# Altium schematic sheet CoinCraftA1.SchDoc (part 2 of 2)
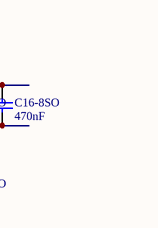
[diagram p6: CoinCraftA1.SchDoc, bottom right]

## Nets
GND: C1.2 C1-1MO.2 C1-1SO.2 C1-2MO.2 C1-2S.2 C1-2SO.2 C1-3MO.2 C1-3S.2 C1-3SO.2 C1-4MO.2 C1-4S.2 C1-4SO.1 C1-5.2 C1-5MO.2 C1-5S.2 C1-5SO.2 C1-6.2 C1-6MO.2 C1-6S.2 C1-6SO.2 C1-7MO.2 C1-7S.2 C1-7SO.2 C1-8MO.2 C1-8S.2 C1-8SO.2 C1_0.2 C1_1.1 C1_1S.2 C1_2.1 C1_3.1 C1_4.1 C1_5.1 C1_6.1 C2-1MO.2 C2-1S.2 C2-1SO.2 C2-2MO.2 C2-2S.2 C2-2SO.2 C2-3MO.2 C2-3S.2 C2-3SO.2 C2-4MO.2 C2-4S.2 C2-4SO.1 C2-5.2 C2-5MO.2 C2-5S.2 C2-5SO.2 C2-6.2 C2-6MO.2 C2-6S.2 C2-6SO.2 C2-7MO.2 C2-7S.2 C2-7SO.2 C2-8MO.2 C2-8S.2 C2-8SO.2 C2_0.2 C2_1.2 C2_2.2 C2_3.2 C2_4.2 C2_5.2 C2_6.2 C3-1MO.2 C3-1S.2 C3-1SO.2 C3-2MO.2 C3-2S.2 C3-2SO.2 C3-3MO.2 C3-3S.2 C3-3SO.2 C3-4MO.2 C3-4S.2 C3-4SO.2 C3-5.2 C3-5MO.2 C3-5S.2 C3-5SO.2 C3-6.2 C3-6MO.2 C3-6S.2 C3-6SO.2 C3-7MO.2 C3-7S.2 C3-7SO.2 C3-8MO.2 C3-8S.2 C3-8SO.2 C3_0.2 C4-1MO.2 C4-1S.2 C4-1SO.2 C4-2MO.2 C4-2S.2 C4-2SO.2 C4-3MO.2 C4-3S.2 C4-3SO.2 C4-4MO.2 C4-4S.2 C4-4SO.2 C4-5.2 C4-5MO.2 C4-5S.2 C4-5SO.2 C4-6.2 C4-6MO.2 C4-6S.2 C4-6SO.2 C4-7MO.2 C4-7S.2 C4-7SO.2 C4-8MO.2 C4-8S.2 C4-8SO.2 C4_0.2 C5-1MO.2 C5-1S.2 C5-1SO.2 C5-2MO.2 C5-2S.2 C5-2SO.1 C5-3MO.2 C5-3S.2 C5-3SO.2 C5-4MO.2 C5-4S.2 C5-4SO.2 C5-5.2 C5-5MO.2 C5-5S.2 C5-5SO.2 C5-6.2 C5-6MO.2 C5-6S.2 C5-6SO.2 C5-7MO.2 C5-7S.2 C5-7SO.2 C5-8MO.2 C5-8S.2 C5-8SO.2 C5_0.2 C6-1MO.2 C6-1S.2 C6-1SO.2 C6-2MO.2 C6-2S.2 C6-2SO.1 C6-3MO.2 C6-3S.2 C6-3SO.2 C6-4MO.2 C6-4S.2 C6-4SO.2 C6-5.2 C6-5MO.2 C6-5S.2 C6-5SO.2 C6-6.2 C6-6MO.2 C6-6S.2 C6-6SO.2 C6-7MO.2 C6-7S.2 C6-7SO.2 C6-8MO.2 C6-8S.2 C6-8SO.2 C6_0.2 C7-1MO.2 C7-1S.2 C7-1SO.2 C7-2MO.2 C7-2S.2 C7-2SO.1 C7-3MO.2 C7-3S.2 C7-3SO.2 C7-4MO.2 C7-4S.2 C7-4SO.2 C7-5.2 C7-5MO.2 C7-5S.2 C7-5SO.2 C7-6.2 C7-6MO.2 C7-6S.2 C7-6SO.2 C7-7MO.2 C7-7S.2 C7-7SO.2 C7-8MO.2 C7-8S.2 C7-8SO.2 C7_0.2 C8-1MO.2 C8-1S.2 C8-1SO.2 C8-2MO.2 C8-2S.2 C8-2SO.1 C8-3MO.2 C8-3S.2 C8-3SO.2 C8-4MO.2 C8-4S.2 C8-4SO.2 C8-5.2 C8-5MO.2 C8-5S.2 C8-5SO.2 C8-6.2 C8-6MO.2 C8-6S.2 C8-6SO.2 C8-7MO.2 C8-7S.2 C8-7SO.2 C8-8MO.2 C8-8S.2 C8-8SO.2 C8_0.2 C9-1MO.2 C9-1S.2 C9-1SO.2 C9-2MO.2 C9-2S.2 C9-2SO.1 C9-3MO.2 C9-3S.2 C9-3SO.1 C9-4MO.2 C9-4S.2 C9-4SO.2 C9-5.2 C9-5MO.2 C9-5S.2 C9-5SO.2 C9-6.2 C9-6MO.2 C9-6S.2 C9-6SO.2 C9-7MO.2 C9-7S.2 C9-7SO.1 C9-8MO.2 C9-8S.2 C9-8SO.2 C9_0.2 C10-1MO.2 C10-1S.2 C10-1SO.2 C10-2MO.2 C10-2S.2 C10-2SO.1 C10-3MO.2 C10-3S.2 C10-3SO.1 C10-4MO.2 C10-4S.2 C10-4SO.2 C10-5.2 C10-5MO.2 C10-5S.2 C10-5SO.2 C10-6.2 C10-6MO.2 C10-6S.2 C10-6SO.2 C10-7MO.2 C10-7S.2 C10-7SO.2 C10-8MO.2 C10-8S.2 C10-8SO.2 C10_0.2 C11-1MO.2 C11-1SO.1 C11-2MO.2 C11-2S.2 C11-2SO.2 C11-3MO.2 C11-3S.2 C11-3SO.2 C11-5.2 C11-5MO.2 C11-5SO.2 C11-6.2 C11-6S.2 C11-7S.2 C11-8MO.2 C11-8SO.2 C11_0.2 C11_1.2 C11_2.2 C11_3.2 C11_4.2 C12-1MO.2 C12-1SO.2 C12-2MO.2 C12-2S.2 C12-2SO.2 C12-3MO.2 C12-3S.2 C12-3SO.1 C12-5.2 C12-5MO.2 C12-5SO.2 C12-6.2 C12-6S.2 C12-7S.2 C12-8MO.2 C12-8SO.2 C12_0.2 C12_1.2 C12_2.2 C12_3.2 C12_4.2 C13-2S.2 C13-3S.2 C13-5.2 C13-5MO.2 C13-5SO.2 C13-6.2 C13-6S.2 C13-7S.2 C13-8MO.2 C13-8SO.2 C13_0.2 C13_1.2 C13_2.2 C13_3.2 C13_4.2 C14-5.2 C14-5MO.2 C14-5SO.2 C14-6.2 C14-8MO.2 C14-8SO.2 C14_0.2 C14_1.2 C14_2.2 C14_3.2 C14_4.2 C15-5.2 C15-6.2 C15-8MO.2 C15-8SO.2 C15_0.2 C15_1.2 C15_2.2 C15_3.2 C15_4.2 C16-5.2 C16-6.2 C16-8MO.2 C16-8SO.2 C16_0.2 C16_1.2 C16_2.2 C16_3.2 C16_4.2 C17.2 C17_0.2 C17_1.2 C17_2.2 C17_3.2 C17_4.2 C18_0.2 C18_1.2 C18_2.2 C18_3.2 C18_4.2 C19_1.2 C19_2.2 C19_3.2 C19_4.2 C20-5.2 C20-6.2 C20_0.2 C20_1.2 C20_2.2 C20_3.2 C20_4.2 C21-5.2 C21-6.2 C21_0.2 C21_1.2 C21_2.2 C21_3.2 C21_4.2 C22-5.2 C22-6.2 C22_0.2 C22_1.2 C22_2.2 C22_3.2 C22_4.2 C23-5.2 C23-6.2 C23_0.2 C23_1.2 C23_2.2 C23_3.2 C23_4.2 C24-5.2 C24-6.2 C24_0.2 C24_1.2 C24_3.2 C24_4.2 C25-5.2 C25-6.2 C25_0.2 C25_1.2 C25_3.2 C25_4.2 C26-5.2 C26-6.2 C26_0.2 C26_1.2 C26_2.2 C26_3.2 C26_4.2 C27-5.2 C27-6.2 C27_0.2 C28_0.2 C31_1.2 C31_2.2 C31_3.2 C31_4.2 C32_1.2 C32_2.2 C32_3.2 C32_4.2 C33_1.2 C33_2.2 C33_3.2 C33_4.2 C34.2 C34_1.2 C34_2.2 C34_3.2 C34_4.2 C35_1.2 C35_2.2 C35_3.2 C35_4.2 C36_1.2 C36_2.2 C36_3.2 C36_4.2 C37_1.2 C37_2.2 C37_3.2 C37_4.2 C38_1.2 C38_2.2 C38_3.2 C38_4.2 C39_1.2 C39_2.2 C39_3.2 C39_4.2 C40_1.2 C40_2.2 C40_3.2 C40_4.2 C40_5.2 C40_6.2 C41_1.2 C41_2.2 C41_3.2 C41_4.2 C41_5.2 C41_6.2 C42_1.2 C42_2.2 C42_3.2 C42_4.2 C42_5.2 C42_6.2 C43.2 C43_1.2 C43_2.2 C43_3.2 C43_4.2 C43_5.2 C43_6.2 C44.2 C44_1.2 C44_2.2 C44_3.2 C44_4.2 C44_5.2 C44_6.2 C45_1.2 C45_2.2 C45_3.2 C45_4.2 C45_5.2 C45_6.2 C46_1.2 C46_2.2 C46_3.2 C46_4.2 C46_5.2 C46_6.2 C47_5.2 C47_6.2 C48_5.2 C48_6.2 C49_5.2 C49_6.2 C50_5.2 C50_6.2 C51_1.2 C51_2.2 C51_3.2 C51_4.2 C51_5.2 C51_6.2 C52_1.2 C52_2.2 C52_3.2 C52_4.2 C52_5.2 C52_6.2 C53_1.2 C53_2.2 C53_3.2 C53_4.2 C53_5.2 C53_6.2 C54_1.2 C54_2.2 C54_3.2 C54_4.2 C54_5.2 C54_6.2 C55_1.2 C55_2.2 C55_3.2 C55_4.2 C55_5.2 C55_6.2 C56_1.2 C56_2.2 C56_3.2 C56_4.2 C57_1.2 C57_2.2 C57_3.2 C57_4.2 C58_1.2 C58_2.2 C58_3.2 C58_4.2 C61_1.2 C61_2.2 C61_3.2 C61_4.2 C61_5.2 C61_6.2 C62_1.2 C62_2.2 C62_3.2 C62_4.2 C62_5.2 C62_6.2 C63.2 C63_1.2 C63_2.2 C63_3.2 C63_4.2 C63_5.2 C63_6.2 C64_1.2 C64_2.2 C64_3.2 C64_4.2 C64_5.2 C64_6.2 C65_1.2 C65_2.2 C65_3.2 C65_4.2 C65_5.2 C65_6.2 C66_1.2 C66_2.2 C66_3.2 C66_4.2 C66_5.2 C66_6.2 C67_1.2 C67_2.2 C67_3.2 C67_4.2 C67_5.2 C67_6.2 C68_1.2 C68_2.2 C68_3.2 C68_4.2 C68_5.2 C68_6.2 C72.2 C73.2 C74.2 C75.2 C76.2 C81_2.2 C82_2.2 C85.2 C86.2 C187.2 C206.1 C211.2 C229.2 C231.2 C233.2 C234.2 C237.2 C248.2 C249.2 C250.2 C251.2 C325.2 C358.2 C359.2 C360.2 C364.2 C366.2 C367.2 C371.2 C374.2 C375.2 C376.2 C377.2 C378.2 C379.2 C383.2 C387.2 C503.2 C504.2 C505.2 C506.2 C507.2 C508.2 C509.2 C510.2 C511.2 C512.2 C513.2 C514.2 C515.2 C516.2 C517.2 C518.2 C519.2 C520.2 C521.2 C522.2 C523.2 C524.2 C525.2 C526.2 C528.2 C529.2 C530.2 C531.2 C532.2 C533.2 C534.2 C536.2 D3.1(A1) D3.2(A2) D4.1(C) D5.1(C) D6.1(C) D7.1(C) D8.2(A) D9.2(A) D14.2(A) D16.2(AAAA) D16.5(C4) J1.3 J2.2 J3.5 J3.6 J3.7 J3.8 J3.9 J4.1 J4.3 J4.5 J5.1 J5.3 J5.5 Q2_1.1(S) Q2_1.2(S) Q2_1.3(S) Q2_2.1(S) Q2_2.2(S) Q2_2.3(S) Q2_3.1(S) Q2_3.2(S) Q2_3.3(S) Q2_4.1(S) Q2_4.2(S) Q2_4.3(S) Q2_5.1(S) Q2_5.2(S) Q2_5.3(S) Q2_6.1(S) Q2_6.2(S) Q2_6.3(S) Q3_1.1(S) Q3_1.2(S) Q3_1.3(S) Q3_2.1(S) Q3_2.2(S) Q3_2.3(S) Q3_3.1(S) Q3_3.2(S) Q3_3.3(S) Q3_4.1(S) Q3_4.2(S) Q3_4.3(S) Q3_5.1(S) Q3_5.2(S) Q3_5.3(S) Q3_6.1(S) Q3_6.2(S) Q3_6.3(S) Q7.2(E) R4.1 R6.1 R7.2 R8.2 R10.2 R15.1 R18.1 R20.1 R32.2 R35.2 R40.1 R59.1 R60.1 R61.1 U1.9(VSS) U1.20(AVSS) U1.25(VSS) U1.41(VSS) U1_1.4(GND) U1_1.9(EP) U1_2.4(GND) U1_2.9(EP) U1_3.4(GND) U1_3.9(EP) U1_4.4(GND) U1_4.9(EP) U1_5.4(GND) U1_5.9(EP) U1_6.4(GND) U1_6.9(EP) U2.16(CLKMUX) U2.21(GND) U3.16(CLKMUX) U3.21(GND) U4.16(CLKMUX) U4.21(GND) U5.16(CLKMUX) U5.21(GND) U6.16(CLKMUX) U6.21(GND) U7.16(CLKMUX) U7.21(GND) U8.16(CLKMUX) U8.21(GND) U9.16(CLKMUX) U9.21(GND) U18.2(GND) U19.6(GND) U19.7(GND) U24.6(GND) U24.7(GND)
0.8V: C1.1 C1-1MO.1 C1-1SO.1 C1-2MO.1 C1-2S.1 C1-2SO.1 C1-3MO.1 C1-3S.1 C1-3SO.1 C1-4MO.1 C1-4S.1 C1-4SO.2 C1-5MO.1 C1-5S.1 C1-5SO.1 C1-6MO.1 C1-6S.1 C1-6SO.1 C1-7MO.1 C1-7S.1 C1-7SO.1 C1-8MO.1 C1-8S.1 C1-8SO.1 C1_0.1 C1_1S.1 C2-1MO.1 C2-1S.1 C2-1SO.1 C2-2MO.1 C2-2S.1 C2-2SO.1 C2-3MO.1 C2-3S.1 C2-3SO.1 C2-4MO.1 C2-4S.1 C2-4SO.2 C2-5MO.1 C2-5S.1 C2-5SO.1 C2-6MO.1 C2-6S.1 C2-6SO.1 C2-7MO.1 C2-7S.1 C2-7SO.1 C2-8MO.1 C2-8S.1 C2-8SO.1 C2_0.1 C3-1MO.1 C3-1S.1 C3-1SO.1 C3-2MO.1 C3-2S.1 C3-2SO.1 C3-3MO.1 C3-3S.1 C3-3SO.1 C3-4MO.1 C3-4S.1 C3-4SO.1 C3-5MO.1 C3-5S.1 C3-5SO.1 C3-6MO.1 C3-6S.1 C3-6SO.1 C3-7MO.1 C3-7S.1 C3-7SO.1 C3-8MO.1 C3-8S.1 C3-8SO.1 C3_0.1 C4-1MO.1 C4-1S.1 C4-1SO.1 C4-2MO.1 C4-2S.1 C4-2SO.1 C4-3MO.1 C4-3S.1 C4-3SO.1 C4-4MO.1 C4-4S.1 C4-4SO.1 C4-5MO.1 C4-5S.1 C4-5SO.1 C4-6MO.1 C4-6S.1 C4-6SO.1 C4-7MO.1 C4-7S.1 C4-7SO.1 C4-8MO.1 C4-8S.1 C4-8SO.1 C4_0.1 C5-1MO.1 C5-1S.1 C5-1SO.1 C5-2MO.1 C5-2S.1 C5-2SO.2 C5-3MO.1 C5-3S.1 C5-3SO.1 C5-4MO.1 C5-4S.1 C5-4SO.1 C5-5MO.1 C5-5S.1 C5-5SO.1 C5-6MO.1 C5-6S.1 C5-6SO.1 C5-7MO.1 C5-7S.1 C5-7SO.1 C5-8MO.1 C5-8S.1 C5-8SO.1 C5_0.1 C6-1MO.1 C6-1S.1 C6-1SO.1 C6-2MO.1 C6-2S.1 C6-2SO.2 C6-3MO.1 C6-3S.1 C6-3SO.1 C6-4MO.1 C6-4S.1 C6-4SO.1 C6-5MO.1 C6-5S.1 C6-5SO.1 C6-6MO.1 C6-6S.1 C6-6SO.1 C6-7MO.1 C6-7S.1 C6-7SO.1 C6-8MO.1 C6-8S.1 C6-8SO.1 C6_0.1 C7-1MO.1 C7-1S.1 C7-1SO.1 C7-2MO.1 C7-2S.1 C7-2SO.2 C7-3MO.1 C7-3S.1 C7-3SO.1 C7-4MO.1 C7-4S.1 C7-4SO.1 C7-5MO.1 C7-5S.1 C7-5SO.1 C7-6MO.1 C7-6S.1 C7-6SO.1 C7-7MO.1 C7-7S.1 C7-7SO.1 C7-8MO.1 C7-8S.1 C7-8SO.1 C7_0.1 C8-1MO.1 C8-1S.1 C8-1SO.1 C8-2MO.1 C8-2S.1 C8-2SO.2 C8-3MO.1 C8-3S.1 C8-3SO.1 C8-4MO.1 C8-4S.1 C8-4SO.1 C8-5MO.1 C8-5S.1 C8-5SO.1 C8-6MO.1 C8-6S.1 C8-6SO.1 C8-7MO.1 C8-7S.1 C8-7SO.1 C8-8MO.1 C8-8S.1 C8-8SO.1 C8_0.1 C9-1MO.1 C9-1S.1 C9-1SO.1 C9-2MO.1 C9-2S.1 C9-2SO.2 C9-3MO.1 C9-3S.1 C9-3SO.2 C9-4MO.1 C9-4S.1 C9-4SO.1 C9-5MO.1 C9-5S.1 C9-5SO.1 C9-6MO.1 C9-6S.1 C9-6SO.1 C9-7MO.1 C9-7S.1 C9-7SO.2 C9-8MO.1 C9-8S.1 C9-8SO.1 C9_0.1 C10-1MO.1 C10-1S.1 C10-1SO.1 C10-2MO.1 C10-2S.1 C10-2SO.2 C10-3MO.1 C10-3S.1 C10-3SO.2 C10-4MO.1 C10-4S.1 C10-4SO.1 C10-5MO.1 C10-5S.1 C10-5SO.1 C10-6MO.1 C10-6S.1 C10-6SO.1 C10-7MO.1 C10-7S.1 C10-7SO.1 C10-8MO.1 C10-8S.1 C10-8SO.1 C10_0.1 C11-1MO.1 C11-1SO.2 C11-2MO.1 C11-2S.1 C11-2SO.1 C11-3MO.1 C11-3S.1 C11-3SO.1 C11-5MO.1 C11-5SO.1 C11-6S.1 C11-7S.1 C11-8MO.1 C11-8SO.1 C11_0.1 C11_1.1 C11_2.1 C11_3.1 C11_4.1 C12-1MO.1 C12-1SO.1 C12-2MO.1 C12-2S.1 C12-2SO.1 C12-3MO.1 C12-3S.1 C12-3SO.2 C12-5MO.1 C12-5SO.1 C12-6S.1 C12-7S.1 C12-8MO.1 C12-8SO.1 C12_0.1 C12_1.1 C12_2.1 C12_3.1 C12_4.1 C13-2S.1 C13-3S.1 C13-5MO.1 C13-5SO.1 C13-6S.1 C13-7S.1 C13-8MO.1 C13-8SO.1 C13_0.1 C13_1.1 C13_2.1 C13_3.1 C13_4.1 C14-5MO.1 C14-5SO.1 C14-8MO.1 C14-8SO.1 C14_0.1 C14_1.1 C14_2.1 C14_3.1 C14_4.1 C15-8MO.1 C15-8SO.1 C15_0.1 C15_1.1 C15_2.1 C15_3.1 C15_4.1 C16-8MO.1 C16-8SO.1 C16_0.1 C16_1.1 C16_2.1 C16_3.1 C16_4.1 C17_0.1 C17_1.1 C17_2.1 C17_3.1 C17_4.1 C18_0.1 C18_1.1 C18_2.1 C18_3.1 C18_4.1 C19_1.1 C19_2.1 C19_3.1 C19_4.1 C20_0.1 C20_1.1 C20_2.1 C20_3.1 C20_4.1 C21_0.1 C21_1.1 C21_2.1 C21_3.1 C21_4.1 C22_0.1 C22_1.1 C22_2.1 C22_3.1 C22_4.1 C23_0.1 C23_1.1 C23_2.1 C23_3.1 C23_4.1 C24_0.1 C24_1.1 C24_3.1 C24_4.1 C25_0.1 C25_1.1 C25_3.1 C25_4.1 C26_0.1 C26_1.1 C26_2.1 C26_3.1 C26_4.1 C27_0.1 C28_0.1 C40_5.1 C40_6.1 C41_5.1 C41_6.1 C42_5.1 C42_6.1 C43_5.1 C43_6.1 C44_5.1 C44_6.1 C45_5.1 C45_6.1 C46_5.1 C46_6.1 C47_5.1 C47_6.1 C48_5.1 C48_6.1 C49_5.1 C49_6.1 C50_5.1 C50_6.1 C51_5.1 C51_6.1 C52_5.1 C52_6.1 C53_5.1 C53_6.1 C54_5.1 C54_6.1 C55_5.1 C55_6.1 C61_1.1 C61_2.1 C61_3.1 C61_4.1 C61_5.1 C61_6.1 C62_1.1 C62_2.1 C62_3.1 C62_4.1 C62_5.1 C62_6.1 C63_1.1 C63_2.1 C63_3.1 C63_4.1 C63_5.1 C63_6.1 C64_1.1 C64_2.1 C64_3.1 C64_4.1 C64_5.1 C64_6.1 C65_1.1 C65_2.1 C65_3.1 C65_4.1 C65_5.1 C65_6.1 C66_1.1 C66_2.1 C66_3.1 C66_4.1 C66_5.1 C66_6.1 C67_1.1 C67_2.1 C67_3.1 C67_4.1 C67_5.1 C67_6.1 C68_1.1 C68_2.1 C68_3.1 C68_4.1 C68_5.1 C68_6.1 C81_2.1 C82_2.1 C358.1 C359.1 C360.1 C364.1 C366.1 C367.1 C371.1 C374.1 C375.1 C376.1 C377.1 C378.1 C379.1 C383.1 C387.1 C503.1 C504.1 C505.1 C506.1 C507.1 C508.1 C509.1 C510.1 C511.1 C512.1 C513.1 C514.1 C515.1 C516.1 C517.1 C518.1 C519.1 C520.1 C521.1 C522.1 C523.1 C524.1 C525.1 C526.1 C528.1 C529.1 C530.1 C531.1 C532.1 C533.1 C534.1 C536.1 L1_1.2 L1_2.2 L1_3.2 L1_4.2 L1_5.2 L1_6.2 R11.2 R14.2 R43.2 U2.1(VDD) U2.8(VDD) U2.9(VDD) U2.10(VDD) U2.11(VDD) U2.19(VDD) U2.20(VDD) U3.1(VDD) U3.8(VDD) U3.9(VDD) U3.10(VDD) U3.11(VDD) U3.19(VDD) U3.20(VDD) U4.1(VDD) U4.8(VDD) U4.9(VDD) U4.10(VDD) U4.11(VDD) U4.19(VDD) U4.20(VDD) U5.1(VDD) U5.8(VDD) U5.9(VDD) U5.10(VDD) U5.11(VDD) U5.19(VDD) U5.20(VDD) U6.1(VDD) U6.8(VDD) U6.9(VDD) U6.10(VDD) U6.11(VDD) U6.19(VDD) U6.20(VDD) U7.1(VDD) U7.8(VDD) U7.9(VDD) U7.10(VDD) U7.11(VDD) U7.19(VDD) U7.20(VDD) U8.1(VDD) U8.8(VDD) U8.9(VDD) U8.10(VDD) U8.11(VDD) U8.19(VDD) U8.20(VDD) U9.1(VDD) U9.8(VDD) U9.9(VDD) U9.10(VDD) U9.11(VDD) U9.19(VDD) U9.20(VDD)
1.8V: C206.2 R22.2 U2.2(AVDD) U2.18(AVDD) U3.2(AVDD) U3.18(AVDD) U4.2(AVDD) U4.18(AVDD) U5.2(AVDD) U5.18(AVDD) U6.2(AVDD) U6.18(AVDD) U7.2(AVDD) U7.18(AVDD) U8.2(AVDD) U8.18(AVDD) U9.2(AVDD) U9.18(AVDD) U24.1(OUTPUT)
3.3V: C34.1 C63.1 C73.1 C74.1 C75.1 C76.1 C211.1 C229.1 C233.1 C234.1 C237.1 C248.1 C249.1 C250.1 J1.2 R1.2 R9.2 R12.1 R17.1 U1.10(VDD) U1.19(AVDD) U1.26(VDD) U1.35(VUSB3V3) U1.38(VDD) U1.57(VDD) U18.4(NC) U18.5(Vout) U19.1(OUTPUT)
5.0V: C1_1.2 C1_2.2 C1_3.2 C1_4.2 C1_5.2 C1_6.2 C231.1 D1_1.1(A1) D1_1.2(A2) D1_2.1(A1) D1_2.2(A2) D1_3.1(A1) D1_3.2(A2) D1_4.1(A1) D1_4.2(A2) D1_5.1(A1) D1_5.2(A2) D1_6.1(A1) D1_6.2(A2) D11.1(C) D12.2(A) J2.1 R47.1 U1_1.7(VCC) U1_2.7(VCC) U1_3.7(VCC) U1_4.7(VCC) U1_5.7(VCC) U1_6.7(VCC) U20.3(Vin) U22.1(OUTPUT) U23.3(Vin)
12V: D8.1(C) D9.1(C) D13.2(A) D14.1(C) F1.1 F2.1 F3.1 F4.1 F5.1 F6.1 F7.1 F8.1 F9.1 F10.1 F11.1 F12.1 J2.3 J4.2 J4.4 J4.6 J5.2 J5.4 J5.6 R21.2 R57.1
12VF1: C31_1.1 C32_1.1 C33_1.1 C34_1.1 C35_1.1 C36_1.1 C37_1.1 C38_1.1 C39_1.1 C40_1.1 C41_1.1 C42_1.1 C43_1.1 C44_1.1 C45_1.1 C46_1.1 C51_1.1 C52_1.1 C53_1.1 C54_1.1 C55_1.1 C56_1.1 C57_1.1 C58_1.1 F1.2 F7.2 Q1_1.5(D) Q1_1.6(D) Q1_1.7(D) Q1_1.8(D)
12VF2: C31_2.1 C32_2.1 C33_2.1 C34_2.1 C35_2.1 C36_2.1 C37_2.1 C38_2.1 C39_2.1 C40_2.1 C41_2.1 C42_2.1 C43_2.1 C44_2.1 C45_2.1 C46_2.1 C51_2.1 C52_2.1 C53_2.1 C54_2.1 C55_2.1 C56_2.1 C57_2.1 C58_2.1 F2.2 F8.2 Q1_2.5(D) Q1_2.6(D) Q1_2.7(D) Q1_2.8(D)
12VF3: C31_3.1 C32_3.1 C33_3.1 C34_3.1 C35_3.1 C36_3.1 C37_3.1 C38_3.1 C39_3.1 C40_3.1 C41_3.1 C42_3.1 C43_3.1 C44_3.1 C45_3.1 C46_3.1 C51_3.1 C52_3.1 C53_3.1 C54_3.1 C55_3.1 C56_3.1 C57_3.1 C58_3.1 F3.2 F9.2 Q1_3.5(D) Q1_3.6(D) Q1_3.7(D) Q1_3.8(D)
12VF4: C31_4.1 C32_4.1 C33_4.1 C34_4.1 C35_4.1 C36_4.1 C37_4.1 C38_4.1 C39_4.1 C40_4.1 C41_4.1 C42_4.1 C43_4.1 C44_4.1 C45_4.1 C46_4.1 C51_4.1 C52_4.1 C53_4.1 C54_4.1 C55_4.1 C56_4.1 C57_4.1 C58_4.1 F4.2 F10.2 Q1_4.5(D) Q1_4.6(D) Q1_4.7(D) Q1_4.8(D)
12VF5: C1-5.1 C2-5.1 C3-5.1 C4-5.1 C5-5.1 C6-5.1 C7-5.1 C8-5.1 C9-5.1 C10-5.1 C11-5.1 C12-5.1 C13-5.1 C14-5.1 C15-5.1 C16-5.1 C20-5.1 C21-5.1 C22-5.1 C23-5.1 C24-5.1 C25-5.1 C26-5.1 C27-5.1 F5.2 F11.2 Q1_5.5(D) Q1_5.6(D) Q1_5.7(D) Q1_5.8(D)
12VF6: C1-6.1 C2-6.1 C3-6.1 C4-6.1 C5-6.1 C6-6.1 C7-6.1 C8-6.1 C9-6.1 C10-6.1 C11-6.1 C12-6.1 C13-6.1 C14-6.1 C15-6.1 C16-6.1 C20-6.1 C21-6.1 C22-6.1 C23-6.1 C24-6.1 C25-6.1 C26-6.1 C27-6.1 F6.2 F12.2 Q1_6.5(D) Q1_6.6(D) Q1_6.7(D) Q1_6.8(D)
BOOT1: C3_1.1 D1_1.3(CC) U1_1.8(BOOT)
BOOT2: C3_2.1 D1_2.3(CC) U1_2.8(BOOT)
BOOT3: C3_3.1 D1_3.3(CC) U1_3.8(BOOT)
BOOT4: C3_4.1 D1_4.3(CC) U1_4.8(BOOT)
BOOT5: C3_5.1 D1_5.3(CC) U1_5.8(BOOT)
BOOT6: C3_6.1 D1_6.3(CC) U1_6.8(BOOT)
C1Rx: U1.58(VCMPST1/RP96/RF0)
C1Tx: U1.59(VCMPST2/RP97/RF1)
CLKIN: R34.1 R35.1 U2.17(CLOCK) U3.17(CLOCK) U4.17(CLOCK) U5.17(CLOCK) U6.17(CLOCK) U7.17(CLOCK) U8.17(CLOCK) U9.17(CLOCK)
CLKIN_MCU: R33.1 R34.2 U1.46(INT0/DMH/RP64/RD0)
CLKIN_MCU1: R33.2 U1.49(VCPCON/RP65/RD1)
CompFB+: C43.1 R11.1 U1.11(AN5/C1IN1+/VBUSON/VBUSST/RPI37/RB5)
CompFB-: C44.1 R14.1 U1.12(AN4/C1IN2-/USBOEN/RPI36/RB4)
CONFIG_N1: U1.42(RTCC/DMLN/RPI72/RD8)
CONFIG_P1: U1.43(ASDA1/DPLN/RPI73/RD9)
CSN4: U1.14(AN2/C2IN2-/VMIO/RPI34/RB2)
CSP4: U1.13(AN3/C2IN1+/VPIO/RPI35/RB3)
D+: D16.1(C1) J3.3 U1.37(D+/RG2)
D-: D16.3(C2) J3.2 U1.36(D-/RG3)
DRVLogic: C2_1.1 C2_2.1 C2_3.1 C2_4.1 C2_5.1 C2_6.1 R17.2 R18.2 U1.55(C3IN1+/VCMPST3/RP71/RD7) U1_1.6(Vlogic) U1_2.6(Vlogic) U1_3.6(Vlogic) U1_4.6(Vlogic) U1_5.6(Vlogic) U1_6.6(Vlogic)
FB: C251.1 R43.1 U1.17(PGEC1/AN6/RPI38/RB6)
GREEN: D5.2(A) U1.47(PGED2/SOSCI/C3IN3-/RPI61/RC13)
HO1: Q1_1.4(G) U1_1.1(HO)
HO2: Q1_2.4(G) U1_2.1(HO)
HO3: Q1_3.4(G) U1_3.1(HO)
HO4: Q1_4.4(G) U1_4.1(HO)
HO5: Q1_5.4(G) U1_5.1(HO)
HO6: Q1_6.4(G) U1_6.1(HO)
LDO3.3V-5.0V: R12.2 R13.1 U24.5(N.C.) U24.8(INPUT)
LDO5.0V: C187.1 D11.2(A) D12.1(C) R2.1 R13.2 R47.2 U18.1(Vin) U18.3(STBY) U19.5(N.C.) U19.8(INPUT)
LM12V: D13.1(C) R21.1 U20.1(Vout) U22.8(INPUT) U23.1(Vout)
LMGND: D3.3(CC) R60.2 U20.2(GND) U22.2(GND) U22.3(GND) U22.4(N.C.) U22.5(N.C.) U22.6(GND) U22.7(GND) U23.2(GND)
LO1: Q2_1.4(G) Q3_1.4(G) U1_1.3(LO)
LO2: Q2_2.4(G) Q3_2.4(G) U1_2.3(LO)
LO3: Q2_3.4(G) Q3_3.4(G) U1_3.3(LO)
LO4: Q2_4.4(G) Q3_4.4(G) U1_4.3(LO)
LO5: Q2_5.4(G) Q3_5.4(G) U1_5.3(LO)
LO6: Q2_6.4(G) Q3_6.4(G) U1_6.3(LO)
Main OSC In: C85.1 U1.39(OSC1/RPI60/RC12) Y1.1
Main OSC Out: C86.1 U1.40(OSC2/CLKO/RC15) Y1.2
MCLR: C72.1 J1.1 R9.1 U1.7(MCLR)
MCU5.0V: R16.1 U1.34(VBUS)
MCU_CS0: R19.2 U1.51(PMBE/RP67/RD3)
MCU_MISO0: Q7.3(C) R1.1 U1.5(C1IN1-/SDI2/PMA4/RPI119/RG7)
MCU_MOSI0: R3.2 U1.6(C2IN3-/SDO2/PMA3/RP120/RG8)
MCU_SCK0: R5.2 U1.4(C1IN3-/SCK2/PMA5/RP118/RG6)
MEAS12: C325.1 R57.2 R61.2 U1.18(PGED1/AN7/RCV/RPI39/RB7)
ORANGE: D7.2(A) U1.45(PMCS1/RPI75/RD11)
PGC: J1.5 U1.15(PGEC3/AN1/VREF-/RPI33/RB1)
PGD: J1.4 U1.16(PGED3/AN0/VREF+/RPI32/RB0)
PWM1H: U1.61(AN25/PWM1H/PMD1/RPI81/RE1)
PWM1L: U1.60(AN24/PWM1L/PMD0/RP80/RE0)
PWM2H: R8.1 U1.63(AN27/PWM2H/PMD3/RPI83/RE3) U1_5.5(IN)
PWM2L: R10.1 U1.62(AN26/PWM2L/PMD2/RP82/RE2) U1_6.5(IN)
PWM3H: R59.2 U1.1(AN29/PWM3H/PMD5/RP85/RE5) U1_3.5(IN)
PWM3L: R7.1 U1.64(AN28/PWM3L/PMD4/RP84/RE4) U1_4.5(IN)
PWM4H: R40.2 U1.3(AN31/PWM4H/PMD7/RP87/RE7) U1_1.5(IN)
PWM4L: R15.2 U1.2(AN30/PWM4L/PMD6/RPI86/RE6) U1_2.5(IN)
RED: D4.2(A) U1.48(PGEC2/SOSCO/C3IN1-/T1CK/RPI62/RC14)
RESET: R22.1 R31.1 R32.1 U2.3(RESET) U3.3(RESET) U4.3(RESET) U5.3(RESET) U6.3(RESET) U7.3(RESET) U8.3(RESET) U9.3(RESET)
RESET_MCU: R31.2 U1.53(PMRD/RP69/RD5)
SPI_CS0: R19.1 R20.2 U2.15(INCS)
SPI_CS1: U2.4(OUTCS) U3.15(INCS)
SPI_CS2: U3.4(OUTCS) U4.15(INCS)
SPI_CS3: U4.4(OUTCS) U5.15(INCS)
SPI_CS4: U5.4(OUTCS) U6.15(INCS)
SPI_CS5: U6.4(OUTCS) U7.15(INCS)
SPI_CS6: U7.4(OUTCS) U8.15(INCS)
SPI_CS7: U8.4(OUTCS) U9.15(INCS)
SPI_CS8: U9.4(OUTCS)
SPI_MISO0: Q7.1(B) U2.14(INMISO)
SPI_MISO1: U2.5(OUTMISO) U3.14(INMISO)
SPI_MISO2: U3.5(OUTMISO) U4.14(INMISO)
SPI_MISO3: U4.5(OUTMISO) U5.14(INMISO)
SPI_MISO4: R23.1 U5.5(OUTMISO) U6.14(INMISO)
SPI_MISO5: U6.5(OUTMISO) U7.14(INMISO)
SPI_MISO6: U7.5(OUTMISO) U8.14(INMISO)
SPI_MISO7: U8.5(OUTMISO) U9.14(INMISO)
SPI_MOSI0: R3.1 R4.2 U2.13(INMOSI)
SPI_MOSI1: U2.6(OUTMOSI) U3.13(INMOSI)
SPI_MOSI2: U3.6(OUTMOSI) U4.13(INMOSI)
SPI_MOSI3: U4.6(OUTMOSI) U5.13(INMOSI)
SPI_MOSI4: R23.2 U5.6(OUTMOSI) U6.13(INMOSI)
SPI_MOSI5: U6.6(OUTMOSI) U7.13(INMOSI)
SPI_MOSI6: U7.6(OUTMOSI) U8.13(INMOSI)
SPI_MOSI7: U8.6(OUTMOSI) U9.13(INMOSI)
SPI_SCK0: R5.1 R6.2 U2.12(INSCK)
SPI_SCK1: U2.7(OUTSCK) U3.12(INSCK)
SPI_SCK2: U3.7(OUTSCK) U4.12(INSCK)
SPI_SCK3: U4.7(OUTSCK) U5.12(INSCK)
SPI_SCK4: U5.7(OUTSCK) U6.12(INSCK)
SPI_SCK5: U6.7(OUTSCK) U7.12(INSCK)
SPI_SCK6: U7.7(OUTSCK) U8.12(INSCK)
SPI_SCK7: U8.7(OUTSCK) U9.12(INSCK)
SPI_SCK8: U9.7(OUTSCK)
SPI_TERM: U9.5(OUTMISO) U9.6(OUTMOSI)
SWN1: C3_1.2 L1_1.1 Q1_1.1(S) Q1_1.2(S) Q1_1.3(S) Q2_1.5(D) Q2_1.6(D) Q2_1.7(D) Q2_1.8(D) Q3_1.5(D) Q3_1.6(D) Q3_1.7(D) Q3_1.8(D) U1_1.2(SW)
SWN2: C3_2.2 L1_2.1 Q1_2.1(S) Q1_2.2(S) Q1_2.3(S) Q2_2.5(D) Q2_2.6(D) Q2_2.7(D) Q2_2.8(D) Q3_2.5(D) Q3_2.6(D) Q3_2.7(D) Q3_2.8(D) U1_2.2(SW)
SWN3: C3_3.2 L1_3.1 Q1_3.1(S) Q1_3.2(S) Q1_3.3(S) Q2_3.5(D) Q2_3.6(D) Q2_3.7(D) Q2_3.8(D) Q3_3.5(D) Q3_3.6(D) Q3_3.7(D) Q3_3.8(D) U1_3.2(SW)
SWN4: C3_4.2 L1_4.1 Q1_4.1(S) Q1_4.2(S) Q1_4.3(S) Q2_4.5(D) Q2_4.6(D) Q2_4.7(D) Q2_4.8(D) Q3_4.5(D) Q3_4.6(D) Q3_4.7(D) Q3_4.8(D) U1_4.2(SW)
SWN5: C3_5.2 L1_5.1 Q1_5.1(S) Q1_5.2(S) Q1_5.3(S) Q2_5.5(D) Q2_5.6(D) Q2_5.7(D) Q2_5.8(D) Q3_5.5(D) Q3_5.6(D) Q3_5.7(D) Q3_5.8(D) U1_5.2(SW)
SWN6: C3_6.2 L1_6.1 Q1_6.1(S) Q1_6.2(S) Q1_6.3(S) Q2_6.5(D) Q2_6.6(D) Q2_6.7(D) Q2_6.8(D) Q3_6.5(D) Q3_6.6(D) Q3_6.7(D) Q3_6.8(D) U1_6.2(SW)
TP1: U1.54(C3IN2-/RP70/RD6)
TP3: U1.52(PMWR/RP68/RD4)
TP5: U1.50(DPH/RP66/RD2)
TP8: U1.33(USBID/RP99/RF3)
TP9: U1.30(AN15/PMA0/RPI47/RB15)
TP10: U1.29(AN14/PMA1/RPI46/RB14)
TP11: U1.28(TDI/AN13/PMA10/RPI45/RB13)
TP12: U1.27(TCK/AN12/PMA11/RPI44/RB12)
TP13: U1.24(TDO/AN11/PMA12/RPI43/RB11)
TP14: U1.23(TMS/AN10/CVREF/PMA13/RPI42/RB10)
TP15: U1.22(AN9/PMA7//RPI41/RB9)
TP16: U1.21(AN8/PMA6/RPI40/RB8)
TP17: U1.8(C2IN1-/PMA2/RPI121/RG9)
U2Rx: U1.31(SDA2/PMA9/RP100/RF4)
U2Tx: U1.32(SCL2/PMA8/RP101/RF5)
USB5.0V: D16.4(C3) D16.6(C4) J3.1 R2.2 R16.2
VCAP: C17.1 U1.56(VCAP)
YELLOW: D6.2(A) U1.44(ASCL1/PMCS2/RPI74/RD10)

Not connected (* = marked no-connect by the designer): J3 4; U19 2(GND) 3(GND) 4(N.C.); U24 2(GND) 3(GND) 4(N.C.)

## Notes on the sheet
- Swapped XCLK1 and XCLK9I
- (near C234) MCU Pins
- (in symbol CON_USB_MINI_1) gnd

## Library data of the parts
C1 C20-5 C20-6 C20_0 C21-5 C21-6 C21_0 C22-5 C22-6 C22_0 C23-5 C23-6 C23_0 C24-5 C24-6 C24_0 C25-5 C25-6 C25_0 C26-5 C26-6 C26_0 C27-5 C27-6 C27_0 C28_0 C51_1-C51_4 C52_1-C52_4 C53_1-C53_4 C54_1-C54_4 C55_1-C55_4 C56_1-C56_4 C57_1-C57_4 C58_1-C58_4 C61_1-C61_6 C62_1-C62_6 C63_1-C63_6 C64_1-C64_6 C65_1-C65_6 C66_1-C66_6 C67_1-C67_6 C68_1-C68_6 C358-C360 C364 C366 C367 C371 C374-C379 C383 C387 C503-C526 C528-C534 C536 = Cap Semi: CL32A227MQVNNNE 220UF 6.3V 20% X5R 1210; Published: 8-Jun-2000; LatestRevisionDate: 29-May-2009; LatestRevisionNote: IPC-7351 Footprint Added.; PackageReference: C1206; Publisher: Altium Limited; PackageDescription: Chip Capacitor
  C1 C20_0 C21_0 C22_0 C23_0 C24_0 C25_0 C26_0 C27_0 C28_0 C358-C360 C364 C366 C367 C371 C374-C379 C383 C387 C503-C526 C528-C534 C536: Value: 220uF
  C20-5 C20-6 C21-5 C21-6 C22-5 C22-6 C23-5 C23-6 C24-5 C24-6 C25-5 C25-6 C26-5 C26-6 C27-5 C27-6 C51_1-C51_4 C52_1-C52_4 C53_1-C53_4 C54_1-C54_4 C55_1-C55_4 C56_1-C56_4 C57_1-C57_4 C58_1-C58_4: Value: (OPT)100uF
  C61_1-C61_6 C62_1-C62_6 C63_1-C63_6 C64_1-C64_6 C65_1-C65_6 C66_1-C66_6 C67_1-C67_6 C68_1-C68_6: Value: (OPT)220uF
C1-1MO C1-2MO C1-3MO C1-4MO C1-5 C1-5MO C1-6 C1-6MO C1-7MO C1-8MO C1_0-C1_6 C2-1MO C2-2MO C2-3MO C2-4MO C2-5 C2-5MO C2-6 C2-6MO C2-7MO C2-8MO C2_0-C2_6 C3-1MO C3-2MO C3-3MO C3-4MO C3-5 C3-5MO C3-6 C3-6MO C3-7MO C3-8MO C3_0-C3_6 C4-1MO C4-2MO C4-3MO C4-4MO C4-5 C4-5MO C4-6 C4-6MO C4-7MO C4-8MO C4_0 C5-1MO C5-2MO C5-3MO C5-4MO C5-5 C5-5MO C5-6 C5-6MO C5-7MO C5-8MO C5_0 C6-1MO C6-2MO C6-3MO C6-4MO C6-5 C6-5MO C6-6 C6-6MO C6-7MO C6-8MO C6_0 C7-1MO C7-2MO C7-3MO C7-4MO C7-5 C7-5MO C7-6 C7-6MO C7-7MO C7-8MO C7_0 C8-1MO C8-2MO C8-3MO C8-4MO C8-5 C8-5MO C8-6 C8-6MO C8-7MO C8-8MO C8_0 C9-1MO C9-2MO C9-3MO C9-4MO C9-5 C9-5MO C9-6 C9-6MO C9-7MO C9-8MO C9_0 C10-1MO C10-2MO C10-3MO C10-4MO C10-5 C10-5MO C10-6 C10-6MO C10-7MO C10-8MO C10_0 C11-1MO C11-2MO C11-3MO C11-5 C11-5MO C11-6 C11-8MO C11_0-C11_4 C12-1MO C12-2MO C12-3MO C12-5 C12-5MO C12-6 C12-8MO C12_0-C12_4 C13-5 C13-5MO C13-6 C13-8MO C13_0-C13_4 C14-5 C14-5MO C14-6 C14-8MO C14_0-C14_4 C15-5 C15-6 C15-8MO C15_0-C15_4 C16-5 C16-6 C16-8MO C16_0-C16_4 C17 C17_0-C17_4 C18_0-C18_4 C19_1-C19_4 C20_1-C20_4 C21_1-C21_4 C22_1-C22_4 C23_1-C23_4 C24_1 C24_3 C24_4 C25_1 C25_3 C25_4 C26_1-C26_4 C31_1-C31_4 C32_1-C32_4 C33_1-C33_4 C34 C34_1-C34_4 C35_1-C35_4 C36_1-C36_4 C37_1-C37_4 C38_1-C38_4 C39_1-C39_4 C40_1-C40_6 C41_1-C41_6 C42_1-C42_6 C43 C43_1-C43_6 C44 C44_1-C44_6 C45_1-C45_6 C46_1-C46_6 C47_5 C47_6 C48_5 C48_6 C49_5 C49_6 C50_5 C50_6 C51_5 C51_6 C52_5 C52_6 C53_5 C53_6 C54_5 C54_6 C55_5 C55_6 C63 C72-C76 C81_2 C82_2 C85 C86 C187 C206 C211 C229 C231 C233 C234 C237 C248-C251 C325 = CAP: Capacitor
  C43 C44 C251: Manufacturer PN: *
C1-1SO C1-2S C1-2SO C1-3S C1-3SO C1-4S C1-4SO C1-5S C1-5SO C1-6S C1-6SO C1-7S C1-7SO C1-8S C1-8SO C1_1S C2-1S C2-1SO C2-2S C2-2SO C2-3S C2-3SO C2-4S C2-4SO C2-5S C2-5SO C2-6S C2-6SO C2-7S C2-7SO C2-8S C2-8SO C3-1S C3-1SO C3-2S C3-2SO C3-3S C3-3SO C3-4S C3-4SO C3-5S C3-5SO C3-6S C3-6SO C3-7S C3-7SO C3-8S C3-8SO C4-1S C4-1SO C4-2S C4-2SO C4-3S C4-3SO C4-4S C4-4SO C4-5S C4-5SO C4-6S C4-6SO C4-7S C4-7SO C4-8S C4-8SO C5-1S C5-1SO C5-2S C5-2SO C5-3S C5-3SO C5-4S C5-4SO C5-5S C5-5SO C5-6S C5-6SO C5-7S C5-7SO C5-8S C5-8SO C6-1S C6-1SO C6-2S C6-2SO C6-3S C6-3SO C6-4S C6-4SO C6-5S C6-5SO C6-6S C6-6SO C6-7S C6-7SO C6-8S C6-8SO C7-1S C7-1SO C7-2S C7-2SO C7-3S C7-3SO C7-4S C7-4SO C7-5S C7-5SO C7-6S C7-6SO C7-7S C7-7SO C7-8S C7-8SO C8-1S C8-1SO C8-2S C8-2SO C8-3S C8-3SO C8-4S C8-4SO C8-5S C8-5SO C8-6S C8-6SO C8-7S C8-7SO C8-8S C8-8SO C9-1S C9-1SO C9-2S C9-2SO C9-3S C9-3SO C9-4S C9-4SO C9-5S C9-5SO C9-6S C9-6SO C9-7S C9-7SO C9-8S C9-8SO C10-1S C10-1SO C10-2S C10-2SO C10-3S C10-3SO C10-4S C10-4SO C10-5S C10-5SO C10-6S C10-6SO C10-7S C10-7SO C10-8S C10-8SO C11-1SO C11-2S C11-2SO C11-3S C11-3SO C11-5SO C11-6S C11-7S C11-8SO C12-1SO C12-2S C12-2SO C12-3S C12-3SO C12-5SO C12-6S C12-7S C12-8SO C13-2S C13-3S C13-5SO C13-6S C13-7S C13-8SO C14-5SO C14-8SO C15-8SO C16-8SO = Cap Semi: Capacitor (Semiconductor SIM Model); Published: 8-Jun-2000; LatestRevisionDate: 29-May-2009; LatestRevisionNote: IPC-7351 Footprint Added.; PackageReference: C1206; Publisher: Altium Limited; PackageDescription: Chip Capacitor
  C1-2S C1-3S C1-4S C1-5S C1-6S C1-7S C1-8S C1_1S C2-1S C2-2S C2-3S C2-4S C2-5S C2-6S C2-7S C2-8S C3-1S C3-2S C3-3S C3-4S C3-5S C3-6S C3-7S C3-8S C4-1S C4-2S C4-3S C4-4S C4-5S C4-6S C4-7S C4-8S C5-1S C5-2S C5-3S C5-4S C5-5S C5-6S C5-7S C5-8S C6-1S C6-2S C6-3S C6-4S C6-5S C6-6S C6-7S C6-8S C7-1S C7-2S C7-3S C7-4S C7-5S C7-6S C7-7S C7-8S C8-1S C8-2S C8-3S C8-4S C8-5S C8-6S C8-7S C8-8S C9-1S C9-2S C9-3S C9-4S C9-5S C9-6S C9-7S C9-8S C10-1S C10-2S C10-3S C10-4S C10-5S C10-6S C10-7S C10-8S C11-2S C11-3S C11-6S C11-7S C12-2S C12-3S C12-6S C12-7S C13-2S C13-3S C13-6S C13-7S: Value: 470nF
D1_1-D1_6 D3 = D_DUAL_A1A2CC3: NOTE: <NOTE>
D4-D7 = LED_2: NOTE: <NOTE>
D8 D9 D14 = D_TVS_UNI: Åäíîïîñî÷åí òðàíñèë, 600W, UBRmin13.3V@1mA; NOTE: <NOTE>
D11-D13 = D_STKY: NOTE: <NOTE>
D16 = D_TVS_QUAD_C1AA2AA5C3C4C6: 4 IO lines TVS; NOTE: <NOTE>
F1-F12 = FUSE: R_BDS: R; NOTE: <NOTE>
J1 = CON5: Connector
J3 = CON_USB_MINI_1: NOTE: <NOTE>
J4 J5 = CON_PCI-E: 4.20mm Male Dual Row Angled Header WR-MPC4
L1_1-L1_6 = L
Q1_1-Q1_6 Q2_1-Q2_6 Q3_1-Q3_6 = MOS_N_D1_S1S2S3G4D5D6D7D8: NOTE: <NOTE>
Q7 = BJT_NPN_B1E2C3: NOTE: <NOTE>
R1-R23 R31-R35 R40 R43 R47 R57 R59-R61 = Res3: Resistor; Published: 8-Jun-2000; LatestRevisionDate: 29-May-2009; LatestRevisionNote: IPC-7351 Footprint Added.; PackageReference: J1-0603; Publisher: Altium Limited; PackageDescription: Chip Resistor
  R1 R3-R6 R19 R20 R22: Value: 1k
  R2 R12 R31 R33 R60: Value: 0
  R7-R11 R14-R16 R18 R40 R57 R59: Value: 10k
  R13 R23: Value: (OPT)0
  R17: Value: (OPT)10k
  R21: Value: 100
  R32: Value: (OPT)1k
  R34 R35: Value: 47
  R43: Value: 10k; Manufacturer PN: *
  R47: Value: 2
  R61: Value: 2.4k
U1_1-U1_6 = DRVFET_LTC4442: Mosfet 12V Dual Bootstrapped PWM Sync Buck Optimised
U2-U9 = COINCRAFTA1: CoinCraft SHA256
U18 = VOLTREG LDO
U19 U22 U24 = IC_LM2931AD-5.0R2G_SO-8
U20 U23 = IC_Vout1GND2Vin3: NOTE: <NOTE>
Y1 = CRYSTAL